# EasyEDA Pro project balance_car.eprj, board PCB4
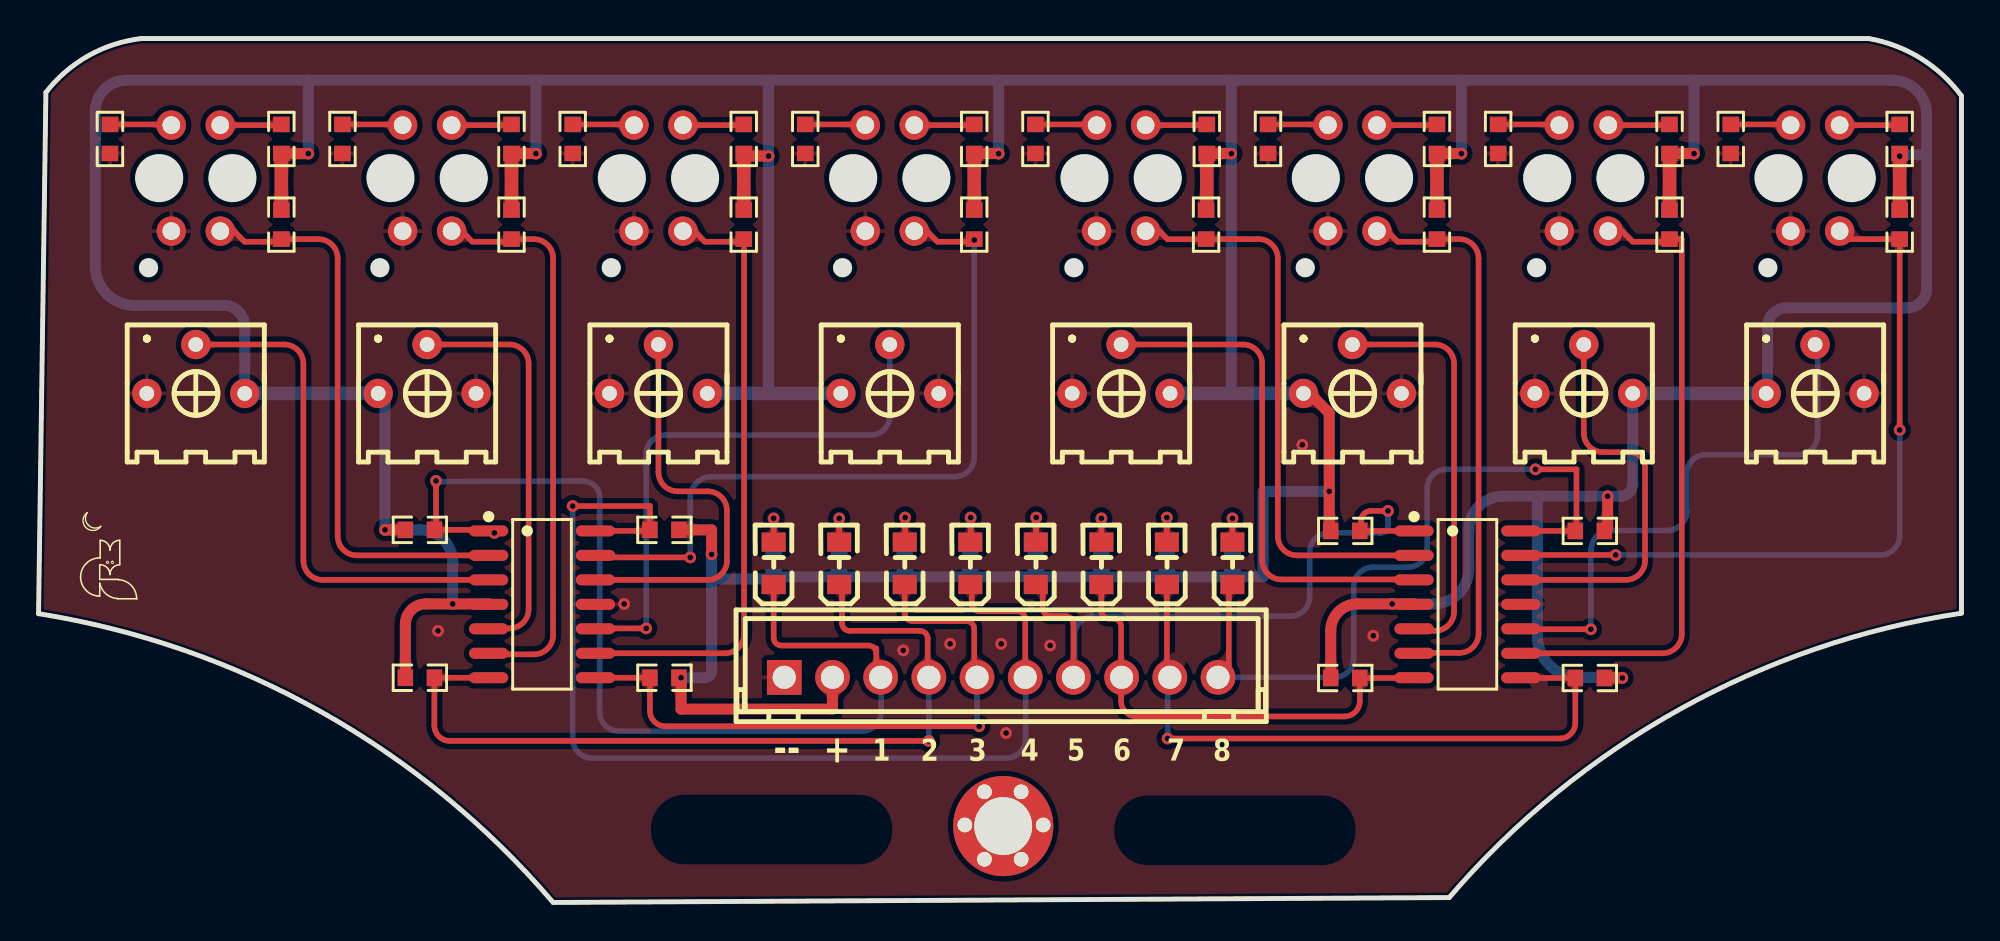
[diagram p8: board, top side]
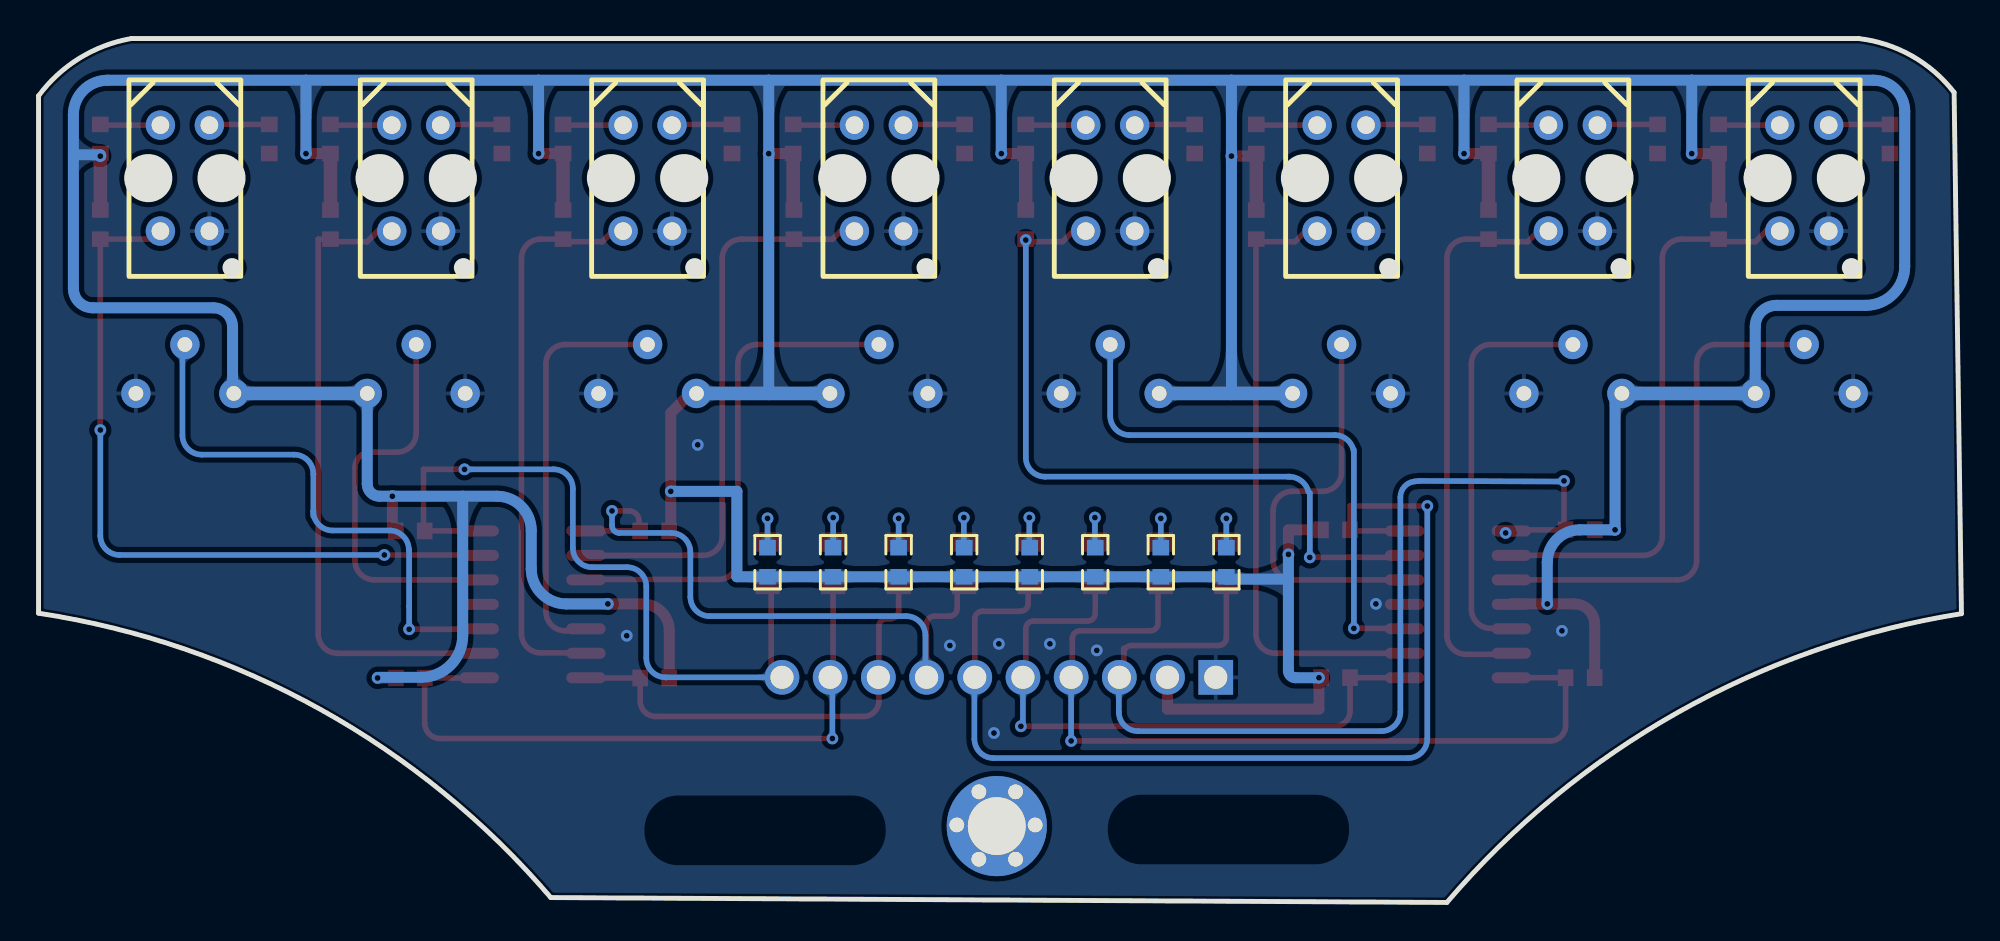
[diagram p9: board, bottom side, seen from below]

Outline 99.75 x 44.84 mm; copper layers: Top Layer, Bottom Layer. Coordinates in mm from the lower left corner of the outline.
Outline path: 0,14.99 0.38,42.04 arc(2.57,43.94) 5.33,44.84 94.93,44.84 arc(97.63,43.81) 99.75,41.86 99.75,15.01 arc(85.13,10.03) 73.17,0.25 26.69,0 arc(14.68,9.88) 0,14.99
Stack: Top Layer 0.035mm / Dielectric1 1.51mm FR4 er 4.5 / Bottom Layer 0.035mm

## Design rules (mm)
template: 自定义配置
spacing copperThickness1oz: track to track 0.102, other pairs 0.152 to 0.3
spacing copperThickness2oz: track to track 0.203, other pairs 0.152 to 0.3
spacing all (default): track to track 0.15, other pairs 0 to 0.3
track width copperThickness1oz: min 0.127, default 0.254, max 2.54
track width copperThickness2oz: min 0.203, default 0.254, max 2.54
track width signal (default): min 0.127, default 0.29, max 2.54
track width power: min 0.35, default 0.57, max 1.2
differential pair differentialPair: width min 0.127, default 0.254, max 2.54; gap min 0.152, default 0.152
differential pair 1 (default): width min 0.127, default 0.254, max 2.54; gap min 0.152, default 0.152
via viaSize: diameter min 0.5, default 0.61, max 10; hole min 0.3, default 0.305, max 6.3
via 1 (default): diameter min 0.5, default 0.61, max 10; hole min 0.3, default 0.305, max 6.3
net GND uses power
net VCC uses power
pour e2933 uses 1

## Placement (name value [footprint] x y rotation side)
CN2  XH-10A  [CONN-TH_10P-P2.50_HCTL_XH-10A]  49.93 11.68 0 top
LED1  XL-2012SURC  [LED0805-RD_RED]  38.13 17.6 90 top
LED2  XL-2012SURC  [LED0805-RD_RED]  41.53 17.6 90 top
LED3  XL-2012SURC  [LED0805-RD_RED]  44.93 17.6 90 top
LED4  XL-2012SURC  [LED0805-RD_RED]  48.33 17.6 90 top
LED5  XL-2012SURC  [LED0805-RD_RED]  51.73 17.6 90 top
LED6  XL-2012SURC  [LED0805-RD_RED]  55.13 17.6 90 top
LED7  XL-2012SURC  [LED0805-RD_RED]  58.53 17.6 90 top
LED8  XL-2012SURC  [LED0805-RD_RED]  61.93 17.6 90 top
NOREF  -  [Pad_e5489]  50.04 3.96 0 top
NOREF#2  -  [Pad_e5484]  49.07 5.74 180 top
NOREF#3  -  [Pad_e5487]  50.97 2.24 180 top
NOREF#4  -  [Pad_e5486]  50.97 5.74 180 top
NOREF#5  -  [Pad_e5485]  49.07 2.24 180 top
NOREF#6  -  [Pad_e5483]  48.05 4.02 180 top
NOREF#7  -  [Pad_e5488]  52.11 4.02 180 top
R5  10K  [R0603]  19.78 19.34 180 top
R6  10K  [R0603]  32.47 19.34 0 top
R7  10K  [R0603]  67.78 19.28 180 top
R8  10K  [R0603]  80.47 19.28 0 top
R13  10K  [R0603]  19.78 11.66 0 top
R14  10K  [R0603]  32.47 11.66 180 top
R15  10K  [R0603]  67.78 11.65 0 top
R16  10K  [R0603]  80.47 11.65 180 top
R17  10K  [R0603]  12.59 35.18 90 top
R18  10K  [R0603]  24.53 35.18 90 top
R19  10K  [R0603]  36.58 35.18 90 top
R20  10K  [R0603]  48.54 35.18 90 top
R21  10K  [R0603]  60.56 35.18 90 top
R22  10K  [R0603]  72.54 35.18 90 top
R23  10K  [R0603]  84.6 35.18 90 top
R24  10K  [R0603]  96.54 35.18 90 top
R25  100R  [R0603]  3.7 39.62 90 top
R26  100R  [R0603]  15.76 39.62 90 top
R27  100R  [R0603]  27.71 39.62 90 top
R28  100R  [R0603]  39.77 39.62 90 top
R29  100R  [R0603]  51.71 39.62 90 top
R30  100R  [R0603]  63.78 39.62 90 top
R31  100R  [R0603]  75.71 39.62 90 top
R32  100R  [R0603]  87.78 39.62 90 top
R33  1K  [R0603]  38.13 17.66 90 bottom
R34  1K  [R0603]  41.53 17.66 90 bottom
R35  1K  [R0603]  44.93 17.66 90 bottom
R36  1K  [R0603]  48.33 17.66 90 bottom
R37  1K  [R0603]  51.73 17.66 90 bottom
R38  1K  [R0603]  55.13 17.66 90 bottom
R39  1K  [R0603]  58.53 17.66 90 bottom
R40  1K  [R0603]  61.93 17.66 90 bottom
R41  300Ω  [R0603]  12.59 39.62 270 top
R42  300Ω  [R0603]  24.53 39.62 270 top
R43  300Ω  [R0603]  36.58 39.62 270 top
R44  300Ω  [R0603]  48.54 39.62 270 top
R45  300Ω  [R0603]  60.6 39.62 270 top
R46  300Ω  [R0603]  72.54 39.62 270 top
R47  300Ω  [R0603]  84.6 39.62 270 top
R48  300Ω  [R0603]  96.54 39.62 270 top
U1  LM324DR2G  [SOIC-14_L8.7-W3.9-P1.27-LS6.0-BL]  26.12 15.47 270 top
U2  LM324DR2G  [SOIC-14_L8.7-W3.9-P1.27-LS6.0-BL]  74.12 15.47 270 top
U3  TCRT5000  [OPTO-TH_TCRT5000]  8.16 37.59 90 bottom
U4  TCRT5000  [OPTO-TH_TCRT5000]  20.16 37.59 90 bottom
U5  TCRT5000  [OPTO-TH_TCRT5000]  32.16 37.59 90 bottom
U6  TCRT5000  [OPTO-TH_TCRT5000]  44.16 37.59 90 bottom
U7  TCRT5000  [OPTO-TH_TCRT5000]  56.16 37.59 90 bottom
U8  TCRT5000  [OPTO-TH_TCRT5000]  68.16 37.59 90 bottom
U9  TCRT5000  [OPTO-TH_TCRT5000]  80.16 37.59 90 bottom
U10  TCRT5000  [OPTO-TH_TCRT5000]  92.16 37.59 90 bottom
VR1  10kΩ  [RES-ADJ-TH_3362P]  8.16 27.69 0 top
VR2  10kΩ  [RES-ADJ-TH_3362P]  20.16 27.69 0 top
VR3  10kΩ  [RES-ADJ-TH_3362P]  32.16 27.69 0 top
VR4  10kΩ  [RES-ADJ-TH_3362P]  44.16 27.69 0 top
VR5  10kΩ  [RES-ADJ-TH_3362P]  56.16 27.69 0 top
VR6  10kΩ  [RES-ADJ-TH_3362P]  68.16 27.69 0 top
VR7  10kΩ  [RES-ADJ-TH_3362P]  80.16 27.69 0 top
VR8  10kΩ  [RES-ADJ-TH_3362P]  92.16 27.69 0 top

## Footprints (pads in the part's own frame, mm; a bottom-side part is the same pattern mirrored in y, then rotated)
CONN-TH_10P-P2.50_HCTL_XH-10A
  rect 1.8x1.8 hole 1.2: 1(-11.25,0)
  round 1.8 hole 1.2: 2(-8.75,0) 3(-6.25,0) 4(-3.75,0) 5(-1.25,0) 6(1.25,0) 7(3.75,0) 8(6.25,0) 9(8.75,0) 10(11.25,0)
LED0805-RD_RED
  rect 1x1.25 smd: 1(-1.1,0) 2(1.1,0)
OPTO-TH_TCRT5000
  round 1.524 hole 0.914: 1(2.75,1.27) 2(2.75,-1.27) 3(-2.75,-1.27) 4(-2.75,1.27)
Pad_e5483
  round 0.762 hole 0.762: 1(0,0)
Pad_e5484
  round 0.762 hole 0.762: 1(0,0)
Pad_e5485
  round 0.762 hole 0.762: 1(0,0)
Pad_e5486
  round 0.762 hole 0.762: 1(0,0)
Pad_e5487
  round 0.762 hole 0.762: 1(0,0)
Pad_e5488
  round 0.762 hole 0.762: 1(0,0)
Pad_e5489
  round 5.2 hole 3: 1(0,0)
R0603
  rect 0.806x0.864 smd: 1(-0.753,0) 2(0.753,0)
RES-ADJ-TH_3362P
  round 1.524 hole 0.762: 1(-2.54,-1.27) 2(0,1.27) 3(2.54,-1.27)
SOIC-14_L8.7-W3.9-P1.27-LS6.0-BL
  oval 0.574x2.038 smd: 1(-3.81,-2.769) 2(-2.54,-2.769) 3(-1.27,-2.769) 4(0,-2.769) 5(1.27,-2.769) 6(2.54,-2.769) 7(3.81,-2.769) 8(3.81,2.769) 9(2.54,2.769) 10(1.27,2.769) 11(0,2.769) 12(-1.27,2.769) 13(-2.54,2.769) 14(-3.81,2.769)

## Nets
As in the schematic.

Pads without a net: NOREF 1; NOREF#2 1; NOREF#3 1; NOREF#4 1; NOREF#5 1; NOREF#6 1; NOREF#7 1

## Via types
v1: diameter 0.61, hole 0.305, Top Layer to Bottom Layer, 47 vias

## Routing (per net, layer and track width the routed paths; a pad name or vN(x,y) marks a point on that pad's centre or on a via; arc(x,y) is an arc through that point)
GND:
  vias: v1(20.72,14.1) v1(30.37,15.49) v1(44.85,13.08) v1(47.28,13.42) v1(49.93,13.42) v1(50.19,8.79) v1(52.47,13.33) v1(65.55,23.75) v1(69.24,13.84)
VCC: length 387.1
  Top Layer w0.57: R15.1 67.03,14.11 arc(67.44,15.09) 68.41,15.49 v1(70.22,15.49) 71.33,15.49 71.35,15.47 ; R44.2 49.81,38.87 v1(49.81,38.86) ; R42.2 25.8,38.87 v1(25.8,38.86) ; VR6.1 65.93,26.42 66.95,25.4 v1(66.95,21.34) 66.95,19.36 R7.2 ; v1(81.39,21.08) 81.39,19.45 R8.2 ; v1(61.87,38.86) 61.87,38.87 R45.2 ; R46.2 73.81,38.87 v1(73.81,38.86) ; R16.1 v1(82.16,11.65) ; CN2.2 41.18,10.03 33.33,10.03 v1(33.33,11.66) R14.1 ; R47.2 85.87,38.87 v1(85.87,38.86) ; v1(37.87,38.73) 36.72,38.73 R43.2 ; R13.1 19.03,14.43 arc(19.34,15.18) 20.09,15.49 v1(21.48,15.49) 23.35,15.49 U1.4 ; 33.6,19.34 34.91,19.34 v1(34.91,18.07) ; 12.59,38.86 v1(13.99,38.86) ; R5.2 v1(17.97,19.34)
  Top Layer w0.7: R45.2 60.6,35.93 R21.2 ; R41.2 R17.2 ; R46.2 R22.2 ; R42.2 R18.2 ; R48.2 R24.2 ; R43.2 R19.2 ; R44.2 R20.2 ; R47.2 R23.2
  Bottom Layer w0.57: 77.75,21.08 77.75,13.84 arc(78.38,12.32) 79.9,11.68 82.16,11.68 ; 77.75,21.08 75.97,21.08 arc(74.71,20.56) 74.19,19.3 74.19,17.31 arc(73.66,16.03) 72.37,15.49 v1(70.22,15.49) ; 77.75,21.08 v1(81.39,21.08) 82.06,21.08 arc(82.51,21.27) 82.7,21.71 VR7.3 ; 13.99,42.67 v1(13.99,38.86) ; 13.99,42.67 25.8,42.67 ; 13.99,42.67 4.56,42.67 arc(3.42,42.2) 2.94,41.05 2.94,33.02 arc(3.54,31.58) 4.97,30.99 9.6,30.99 arc(10.37,30.67) 10.7,29.89 VR1.3 ; v1(96.54,38.73) 96.54,38.8 97.94,38.8 97.94,40.89 arc(97.42,42.15) 96.16,42.67 85.87,42.67 ; 37.87,26.42 v1(37.87,38.73) 37.87,42.67 ; v1(66.95,21.34) 63.52,21.34 63.52,16.9 R40.1 R39.1 R38.1 R37.1 R36.1 R35.1 R34.1 R33.1 38.13,16.78 34.91,16.78 ; 73.81,42.67 v1(73.81,38.86) ; 73.81,42.67 85.87,42.67 ; 73.81,42.67 61.87,42.67 ; 49.81,42.67 v1(49.81,38.86) ; 49.81,42.67 37.87,42.67 ; 49.81,42.67 61.87,42.67 ; v1(33.33,11.66) 34.54,11.66 arc(34.8,11.77) 34.91,12.03 34.91,16.78 ; 37.87,42.67 25.8,42.67 ; 85.87,42.67 v1(85.87,38.86) ; 25.8,42.67 v1(25.8,38.86) ; v1(34.91,18.07) 34.91,16.78 ; 61.87,42.67 v1(61.87,38.86) 61.87,26.42 ; VR8.1 89.68,26.42 89.68,29.86 arc(89.98,30.57) 90.68,30.86 96.94,30.86 arc(97.65,31.15) 97.94,31.86 97.94,38.73 ; VR2.1 17.97,26.42 v1(17.97,19.34) 19.8,19.34 arc(20.99,18.84) 21.48,17.65 v1(21.48,15.49)
  Bottom Layer w0.7: VR5.3 VR6.1 ; VR7.3 VR8.1 ; VR3.3 VR4.1 ; VR1.3 VR2.1
IN1: length 29.8
  Top Layer w0.29: U3.4 10.14,34.84 10.69,34.29 12.46,34.29 R17.1 14.52,34.43 arc(15.22,34.13) 15.52,33.43 15.52,19.01 arc(15.81,18.31) 16.52,18.01 U1.2
IN2: length 29.6
  Top Layer w0.29: U1.6 23.4,12.88 25.69,12.88 arc(26.4,13.17) 26.69,13.88 26.69,33.43 arc(26.4,34.13) 25.69,34.43 R18.1 24.4,34.29 22.5,34.29 21.95,34.84 U4.4
IN3: length 31.7
  Top Layer w0.29: U5.4 34.01,34.84 34.57,34.29 36.44,34.29 R19.1 ; U1.9 35.6,12.93 arc(36.3,13.23) 36.6,13.93 36.6,33.94
IN4: length 38.8
  Top Layer w0.29: U1.13 28.99,17.91 v1(33.8,17.91) ; U6.4 46.08,34.84 46.63,34.29 48.4,34.29 R20.1
  Bottom Layer w0.29: 34.84,22.1 47.54,22.1 arc(48.24,22.39) 48.54,23.1 v1(48.54,34.38) ; 34.84,22.1 arc(34.89,22.1) 34.95,22.1 ; 34.84,22.1 arc(34.23,21.87) 33.87,21.33 ; 33.88,21.32 33.8,21.24 v1(33.8,17.91)
IN5: length 29.7
  Top Layer w0.29: 71.35,18.01 65.28,18.01 arc(64.58,18.31) 64.28,19.01 64.28,33.43 arc(63.99,34.13) 63.28,34.43 R21.1 60.56,34.42 58.57,34.42 58.14,34.84 U7.4
IN6: length 29.5
  Top Layer w0.29: 71.35,12.93 71.35,12.95 73.7,12.95 arc(74.4,13.25) 74.7,13.95 74.7,33.43 arc(74.4,34.13) 73.7,34.43 R22.1 72.4,34.29 70.51,34.29 69.95,34.84 U8.4
IN7: length 33.3
  Top Layer w0.29: R23.1 85.24,34.43 85.24,13.93 arc(84.95,13.23) 84.24,12.93 U2.9 ; U9.4 82.15,34.84 82.7,34.29 84.47,34.29
IN8: length 39.2
  Top Layer w0.29: v1(96.54,24.52) R24.1 93.43,34.43 U10.4 ; v1(81.81,18.03) 76.91,18.03 U2.13
  Bottom Layer w0.29: v1(81.81,18.03) 95.54,18.03 arc(96.25,18.33) 96.54,19.03 v1(96.54,24.52)
X1: length 53.4
  Top Layer w0.29: U1.1 23.29,19.34 R5.1 20.62,19.42 v1(20.62,21.88) ; 43.46,12.93 43.46,11.68 CN2.3 ; 43.46,12.93 43.46,13.19 ; 43.46,12.93 arc(43.34,13.22) 43.06,13.33 38.53,13.33 arc(38.25,13.45) 38.13,13.73 LED1.1
  Bottom Layer w0.29: CN2.3 43.71,11.68 43.71,9.89 arc(43.42,9.18) 42.71,8.89 30.1,8.89 arc(29.4,9.18) 29.1,9.89 29.1,21.02 arc(28.9,21.58) 28.37,21.85 28.11,21.88 20.65,21.84 v1(20.62,21.88)
  vias: v1(23.64,19.18)
X2: length 43.8
  Top Layer w0.29: LED2.1 41.68,16.5 41.68,14.5 arc(41.79,14.21) 42.08,14.1 45.72,14.1 arc(46.01,13.98) 46.12,13.7 46.12,11.68 CN2.4 ; v1(46.18,8.38) 21.33,8.38 arc(20.77,8.62) 20.53,9.18 R13.2 U1.7
  Bottom Layer w0.29: CN2.4 v1(46.18,8.38)
X3: length 32.9
  Top Layer w0.29: U1.8 31.64,11.66 31.67,11.62 ; LED3.1 44.93,15 arc(45.05,14.72) 45.33,14.6 48.14,14.6 arc(48.42,14.49) 48.54,14.2 48.54,11.68 CN2.5 ; v1(48.79,9.14) 32.51,9.14 arc(31.95,9.38) 31.71,9.94 31.71,11.66
  Bottom Layer w0.29: CN2.5 48.68,9.14 v1(48.79,9.14)
X4: length 55.3
  Top Layer w0.29: LED4.1 48.41,16.5 48.41,15.51 arc(48.53,15.23) 48.81,15.11 50.78,15.11 arc(51.07,15) 51.18,14.71 CN2.6 ; U1.14 31.66,19.28 31.71,19.34 31.71,20.57 v1(27.71,20.57)
  Bottom Layer w0.29: CN2.6 51.2,11.68 51.2,8.49 arc(50.91,7.79) 50.2,7.49 28.71,7.49 arc(28,7.79) 27.71,8.49 v1(27.71,20.57)
X5: length 35
  Top Layer w0.29: CN2.7 53.68,14.46 arc(53.57,14.74) 53.28,14.86 52.49,14.86 arc(52.21,14.98) 52.09,15.26 52.09,16.5 LED5.1 ; 68.6,19.28 71.35,19.28 ; 68.6,19.28 68.6,19.81 arc(68.75,20.17) 69.11,20.32 v1(70,20.32) ; 68.6,19.28 R7.1
  Bottom Layer w0.29: CN2.7 53.74,11.68 53.74,13.86 arc(54.04,14.57) 54.74,14.86 64.93,14.86 arc(65.64,15.15) 65.93,15.86 65.93,18.18 arc(66.23,18.88) 66.93,19.18 69.62,19.18 arc(69.89,19.29) 70,19.56 v1(70,20.32)
X6: length 24.1
  Top Layer w0.29: LED6.1 55.13,15.13 arc(55.25,14.85) 55.53,14.73 55.76,14.73 arc(56.04,14.61) 56.16,14.33 56.16,11.68 ; 56.16,11.68 56.16,10.45 arc(56.39,9.89) 56.96,9.65 67.74,9.65 arc(68.3,9.89) 68.54,10.45 R15.2 71.34,11.65 71.35,11.66 ; 56.16,11.68 CN2.8
X7: length 35
  Top Layer w0.29: U2.8 76.9,11.65 R16.2 79.72,9.31 arc(79.48,8.74) 78.92,8.51 v1(58.57,8.51) ; LED7.1 58.53,11.68 CN2.9
  Bottom Layer w0.29: CN2.9 58.57,11.57 v1(58.57,8.51)
X8: length 39.8
  Top Layer w0.29: CN2.10 61.74,11.68 61.74,16.31 LED8.1 ; 77.52,22.48 79.78,22.48 79.78,19.34 R8.1 U2.14
  Bottom Layer w0.29: 60.55,11.68 67.22,11.68 arc(67.93,11.98) 68.22,12.68 68.22,16.4 arc(68.51,17.11) 69.22,17.4 71.03,17.4 arc(71.74,17.69) 72.03,18.4 72.03,21.48 arc(72.32,22.19) 73.03,22.48 77.49,22.48 77.49,22.51
  vias: v1(77.65,22.48)
$1N2581: length 26.5
  Top Layer w0.29: U1.3 14.74,16.74 arc(14.03,17.04) 13.74,17.74 13.74,27.96 arc(13.44,28.66) 12.74,28.96 VR1.2
$1N2582: length 21.2
  Top Layer w0.29: VR2.2 24.42,28.96 arc(25.13,28.66) 25.42,27.96 25.42,15.22 arc(25.13,14.52) 24.42,14.22 23.37,14.22 U1.5
$1N2583: length 29.8
  Top Layer w0.29: 28.38,14.2 28.4,14.22 v1(31.52,14.22)
  Bottom Layer w0.29: 31.52,23.49 v1(31.52,14.22) ; VR4.2 44.16,25.26 arc(43.86,24.55) 43.16,24.26 32.52,24.26 arc(31.85,24) 31.52,23.37
$1N2584: length 21.3
  Top Layer w0.29: VR3.2 32.16,22.34 arc(32.45,21.63) 33.16,21.34 34.71,21.34 arc(35.42,21.04) 35.71,20.34 35.71,17.74 arc(35.42,17.04) 34.71,16.74 U1.12
$1N2611: length 26.5
  Top Layer w0.29: 71.35,16.74 71.33,16.76 64.47,16.76 arc(63.77,17.06) 63.47,17.76 63.47,27.96 arc(63.18,28.66) 62.47,28.96 VR5.2
$1N2612: length 21.5
  Top Layer w0.29: 71.35,14.2 71.35,14.1 72.43,14.1 arc(73.13,14.39) 73.43,15.1 73.43,27.96 arc(73.13,28.66) 72.43,28.96 VR6.2
$1N2613: length 28.6
  Top Layer w0.29: U2.10 76.9,14.22 76.94,14.18 v1(80.52,14.18)
  Bottom Layer w0.29: 85.49,20.3 85.49,22.24 arc(85.79,22.95) 86.49,23.24 91.28,23.24 arc(91.99,23.53) 92.28,24.24 92.28,28.96 ; 85.49,20.3 85.49,20.05 ; 85.49,20.3 arc(85.2,19.6) 84.49,19.3 81.54,19.3 arc(80.83,19.01) 80.54,18.3 80.52,18.3 80.52,15.47 ; 80.54,15.37 80.52,15.35 v1(80.52,14.18)
$1N2614: length 20.6
  Top Layer w0.29: U2.12 82.33,16.74 arc(83.04,17.04) 83.33,17.74 83.33,22.57 arc(83.1,23.13) 82.53,23.37 81.16,23.37 arc(80.45,23.66) 80.16,24.37 VR7.2
$1N2615: length 2.8
  Top Layer w0.29: v1(38.13,19.93) LED1.2
  Bottom Layer w0.29: v1(38.13,19.93) 38.13,18.41
$1N2616: length 2.8
  Top Layer w0.29: v1(41.53,19.93) LED2.2
  Bottom Layer w0.29: v1(41.53,19.93) 41.53,18.41
$1N2617: length 2.9
  Top Layer w0.29: LED3.2 44.95,18.7 v1(44.95,19.98)
  Bottom Layer w0.29: 44.93,18.41 44.95,18.41 v1(44.95,19.98)
$1N2618: length 2.9
  Top Layer w0.29: v1(48.35,19.98) 48.35,18.7 LED4.2
  Bottom Layer w0.29: 48.33,18.41 48.35,18.41 v1(48.35,19.98)
$1N2652: length 2.8
  Top Layer w0.29: v1(58.53,19.98) 58.53,18.7 LED7.2
  Bottom Layer w0.29: 58.53,18.41 58.53,18.41 v1(58.53,19.98)
$1N2653: length 2.8
  Top Layer w0.29: v1(61.93,19.93) LED8.2
  Bottom Layer w0.29: v1(61.93,19.93) 61.93,18.41
$1N2654: length 3.2
  Top Layer w0.29: U3.2 6.85,40.38 R25.2
$1N2660: length 3.1
  Top Layer w0.29: U4.2 18.85,40.38 R26.2
$1N2666: length 3.2
  Top Layer w0.29: U5.2 30.85,40.38 R27.2
$1N2672: length 3.1
  Top Layer w0.29: U6.2 42.85,40.38 R28.2
$1N2678: length 3.2
  Top Layer w0.29: R29.2 54.85,40.38 U7.2
$1N2684: length 3.1
  Top Layer w0.29: R30.2 66.85,40.38 U8.2
$1N2690: length 3.2
  Top Layer w0.29: U9.2 78.85,40.38 R31.2
$1N2696: length 3.1
  Top Layer w0.29: U10.2 90.85,40.38 R32.2
$1N2698: length 2.8
  Top Layer w0.29: v1(55.13,19.93) LED6.2
  Bottom Layer w0.29: v1(55.13,19.93) 55.13,18.41
$1N2699: length 2.9
  Top Layer w0.29: LED5.2 51.75,18.7 v1(51.75,19.98)
  Bottom Layer w0.29: 51.73,18.41 51.75,18.41 v1(51.75,19.98)
$1N4632: length 3.2
  Top Layer w0.29: R41.1 12.56,40.34 U3.1
$1N4675: length 3.1
  Top Layer w0.29: R42.1 24.5,40.34 U4.1
$1N4718: length 3.2
  Top Layer w0.29: U5.1 36.54,40.34 R43.1
$1N4761: length 3.1
  Top Layer w0.29: U6.1 48.5,40.34 R44.1
$1N4804: length 3.2
  Top Layer w0.29: R45.1 60.56,40.34 U7.1
$1N4847: length 3.1
  Top Layer w0.29: R46.1 72.5,40.34 U8.1
$1N4890: length 3.2
  Top Layer w0.29: R47.1 84.57,40.34 U9.1
$1N4930: length 3.1
  Top Layer w0.29: R48.1 96.51,40.34 U10.1

## Copper pours and planes (outline as drawn; the poured copper is in the pictures)
GND on Top Layer: -1.5,48.13 101.11,48.13 101.11,-2.29 -1.5,-2.29
GND on Bottom Layer: -0.87,45.97 100.73,45.97 100.73,-0.51 -0.87,-0.51

Small or netless copper shapes (teardrops, artwork), in the pictures only: 199 on Top Layer, 98 on Bottom Layer

## Text on the board
Top Silkscreen Layer: -- | + | 1 | 2 | 3 | 4 | 5 | 6 | 7 | 8
